# EasyEDA Pro project BlueberryPi.eprj, schematic BlueberryPi Board, sheets 1 to 8 of 13

## Sheets
1 REVISION HISTORY: Create Date: 2023-07-02; Page Name: REVISION HISTORY; Project Name: BlueberryPi; Schematic Name: BlueberryPi Board; Update Date: 2023-07-02; Company: 嘉立创EDA; Page Size: A4; Version: V1.0
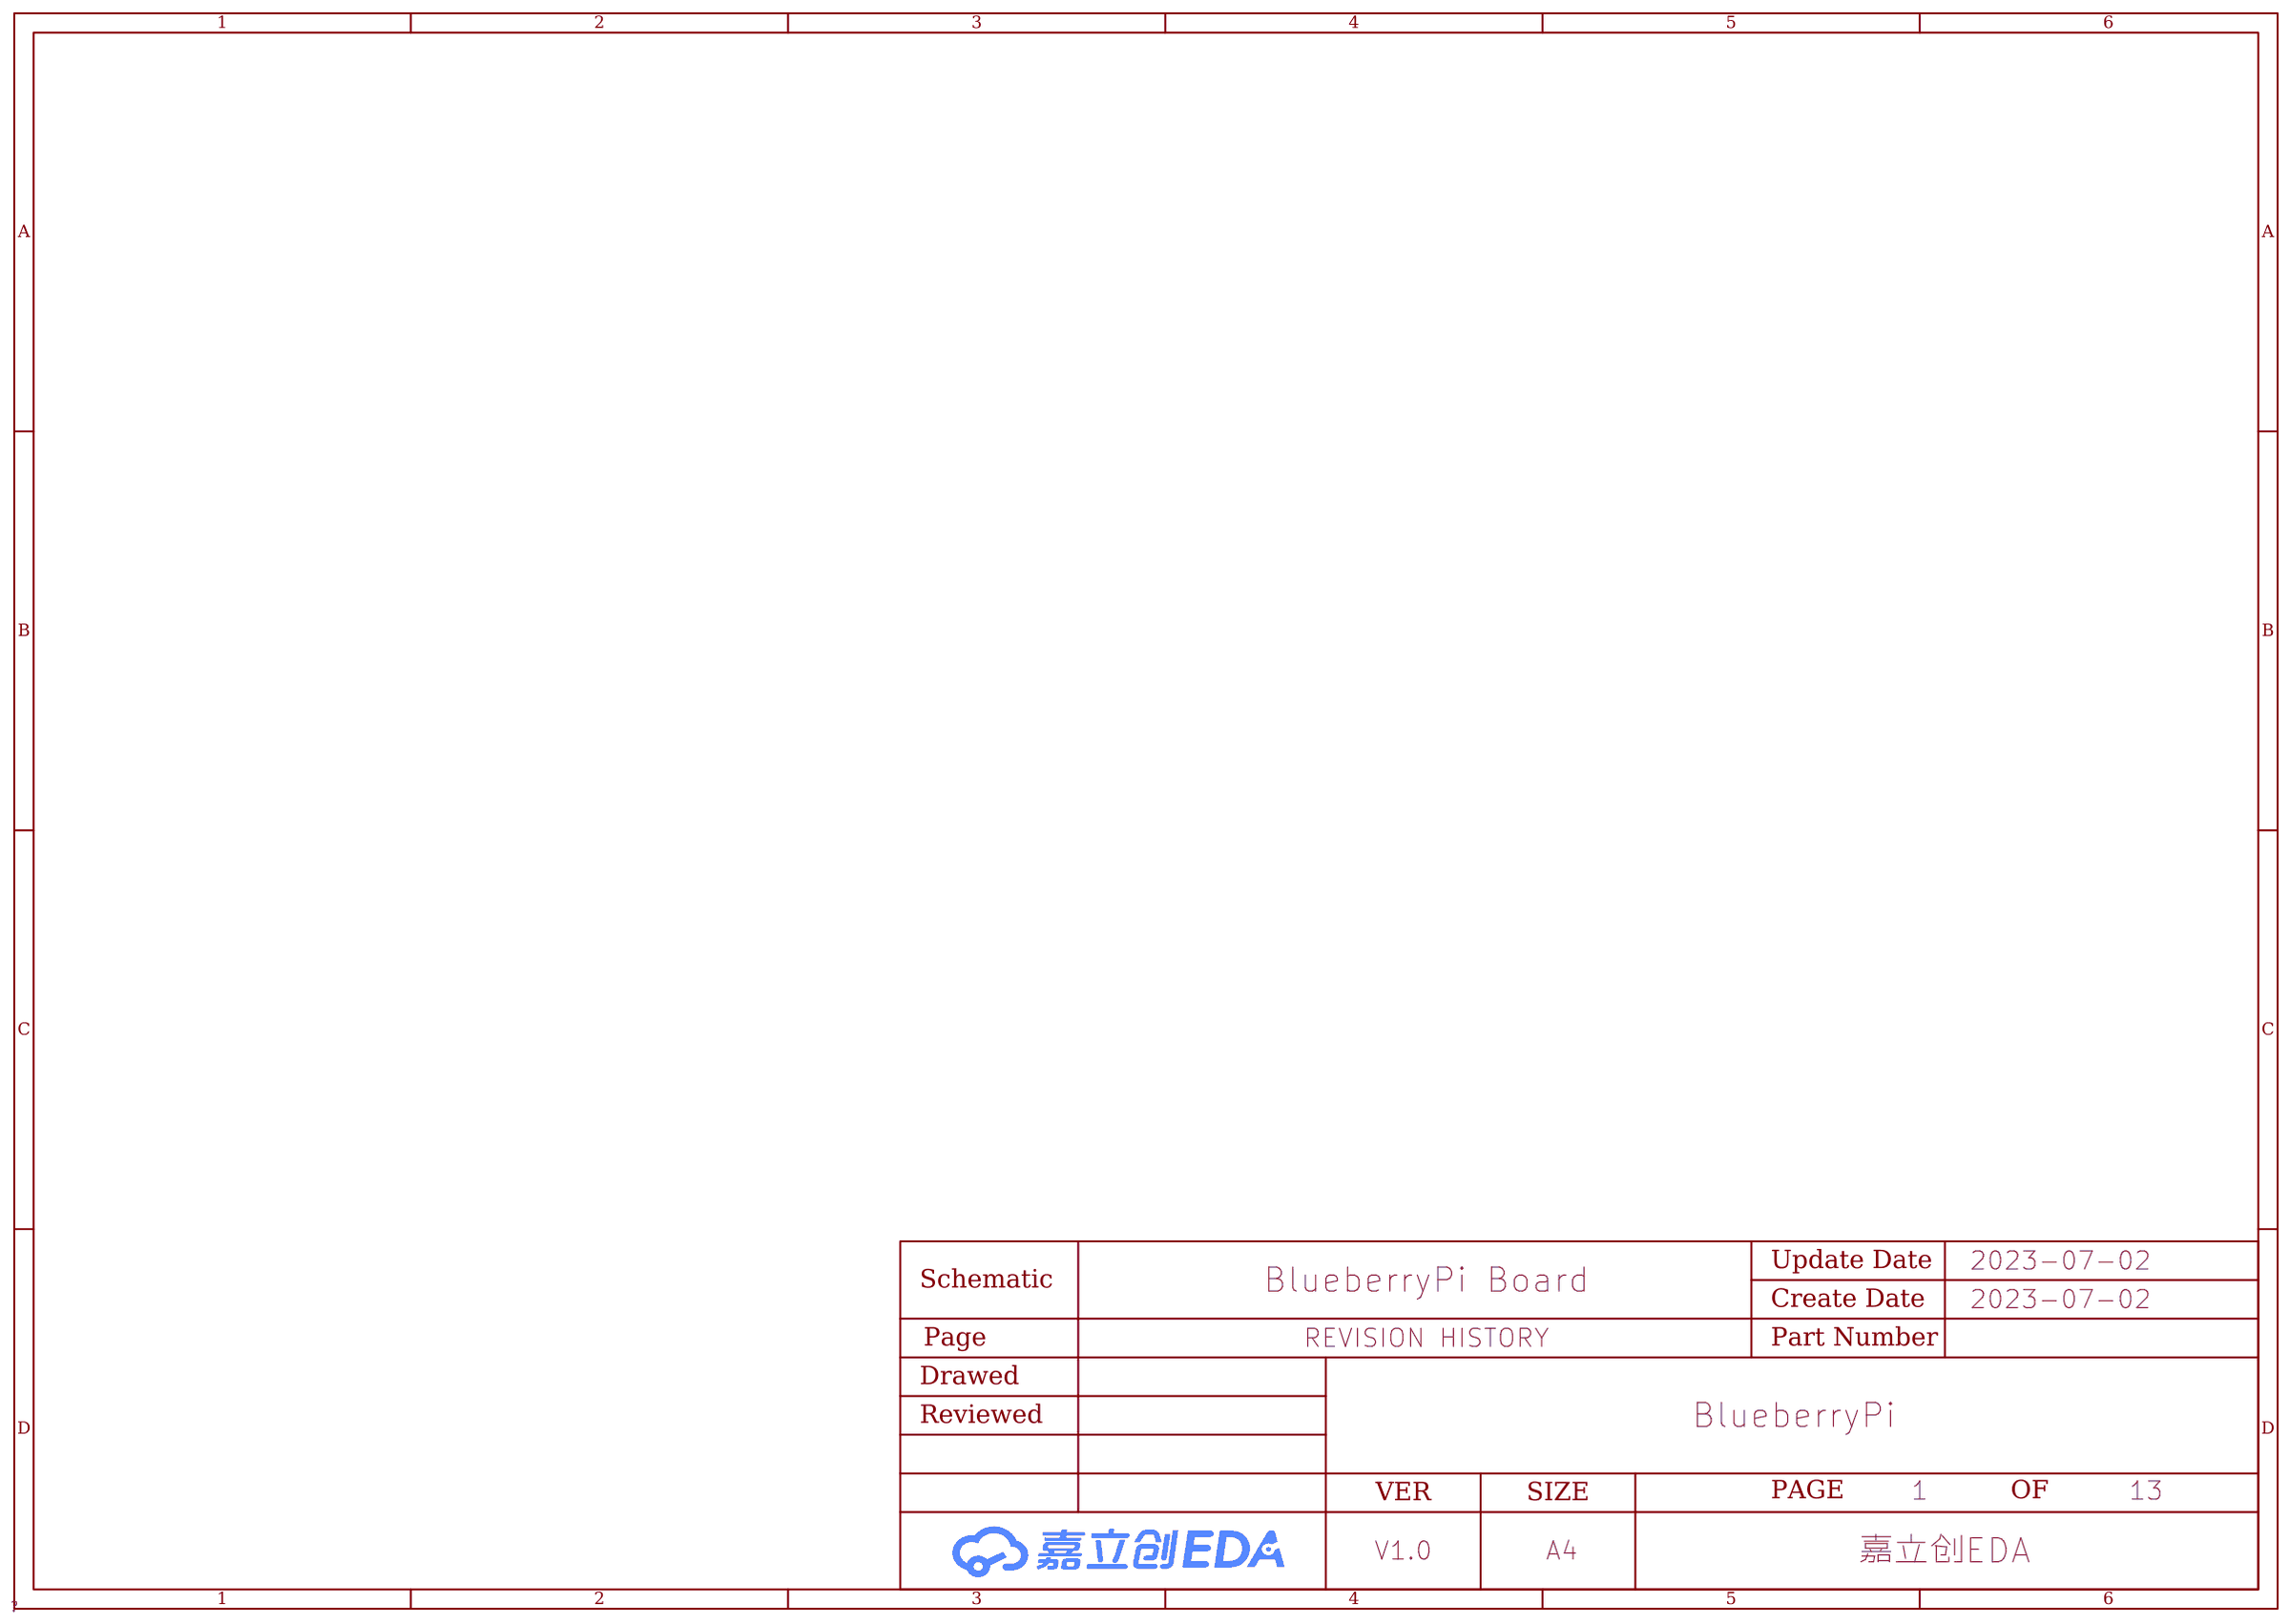
[diagram p0: REVISION HISTORY]
2 BLOCK: Page Name: BLOCK
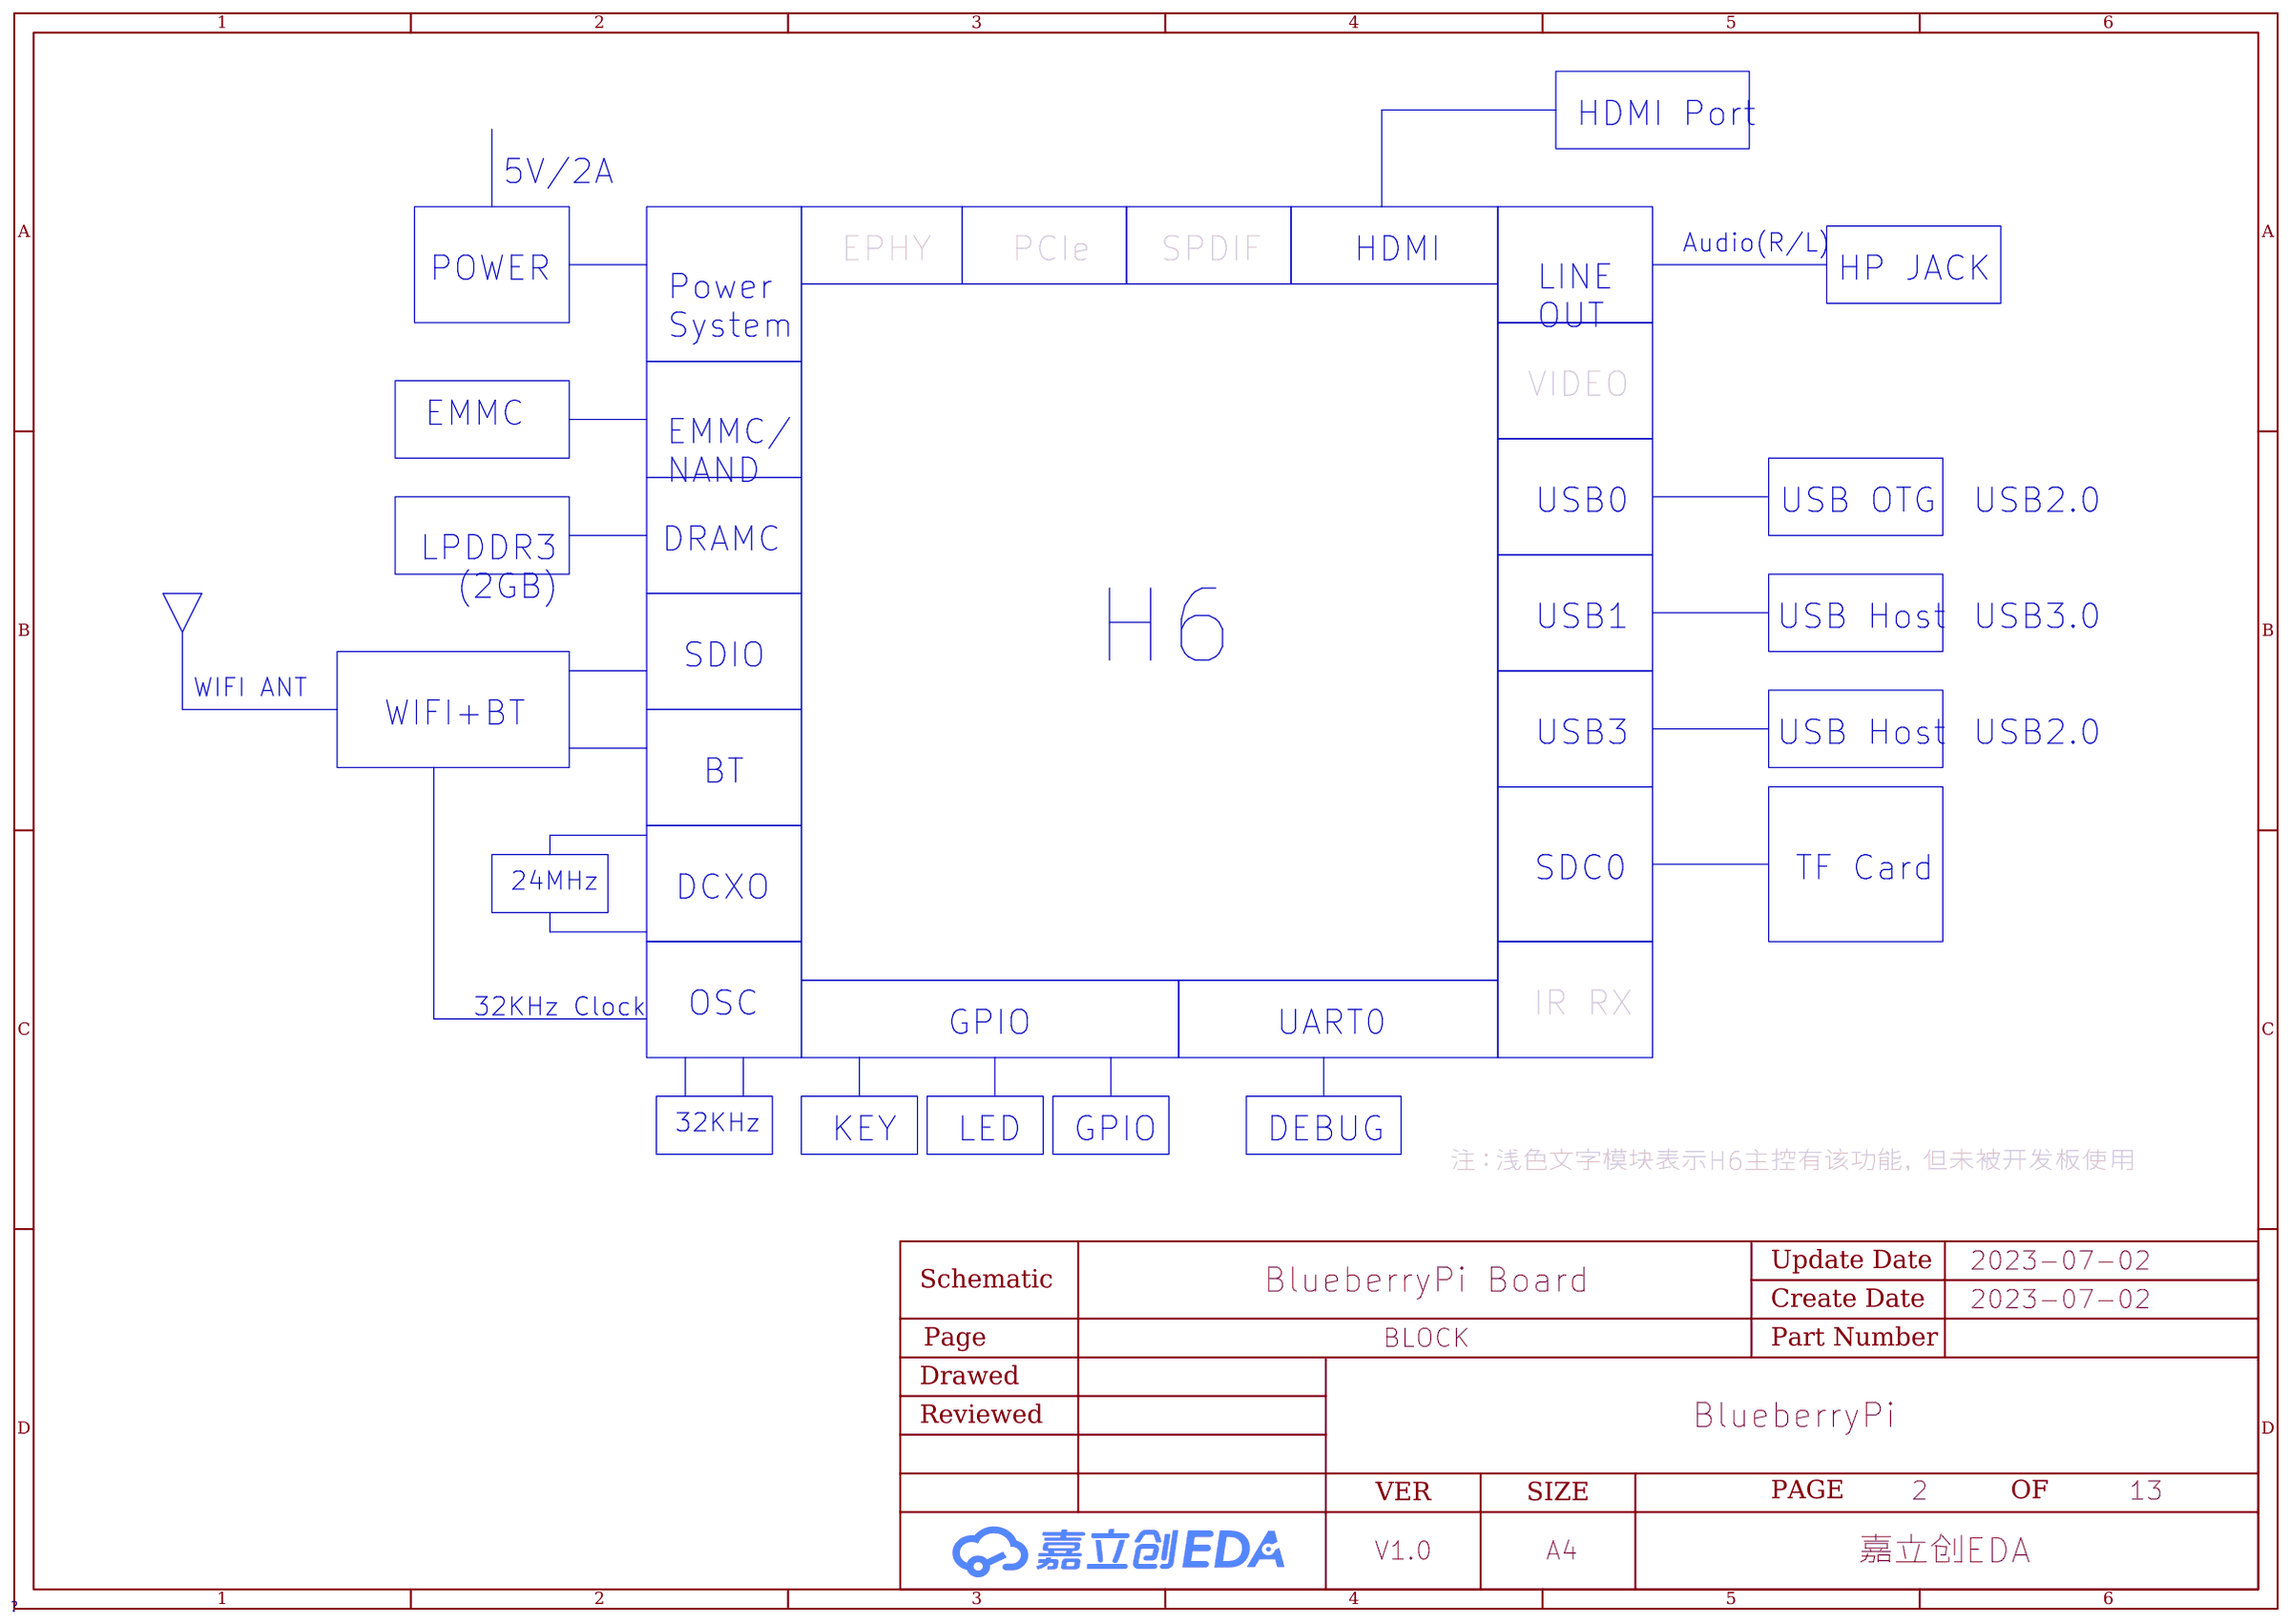
[diagram p1: BLOCK]
3 POWER TREE: Page Name: POWER TREE
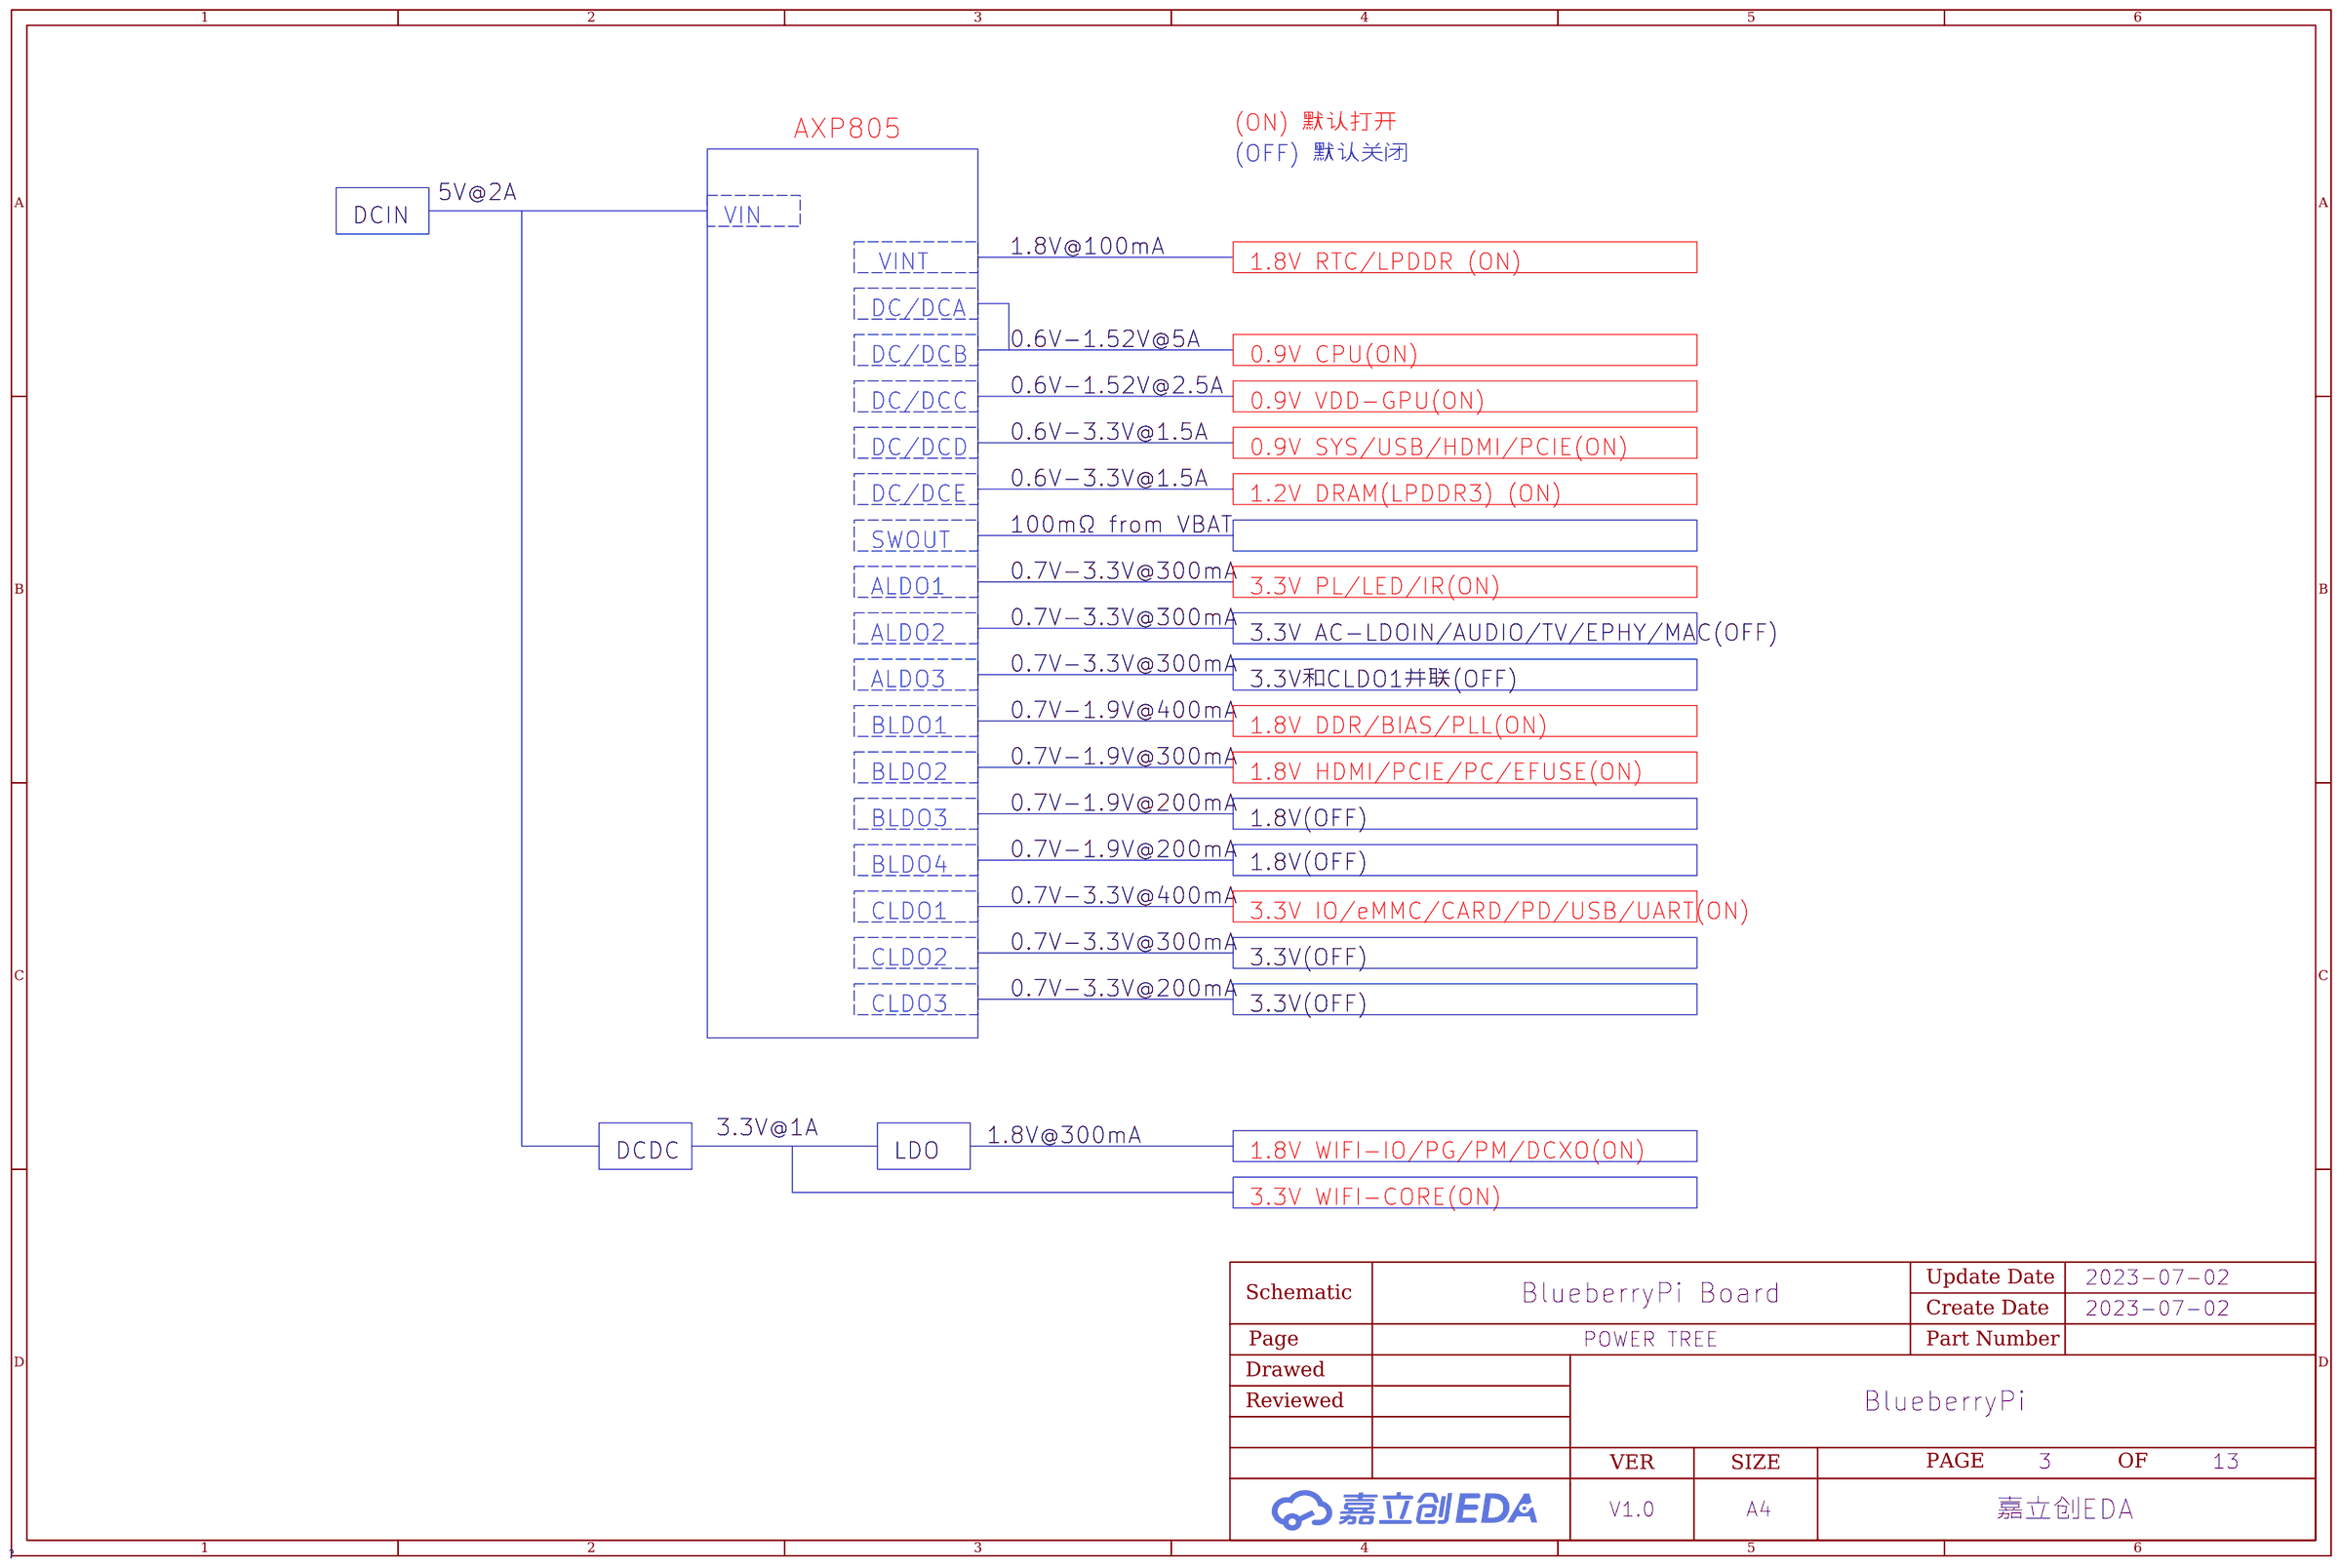
[diagram p2: POWER TREE]
4 GPIO ASSIGNMENT: Page Name: P4
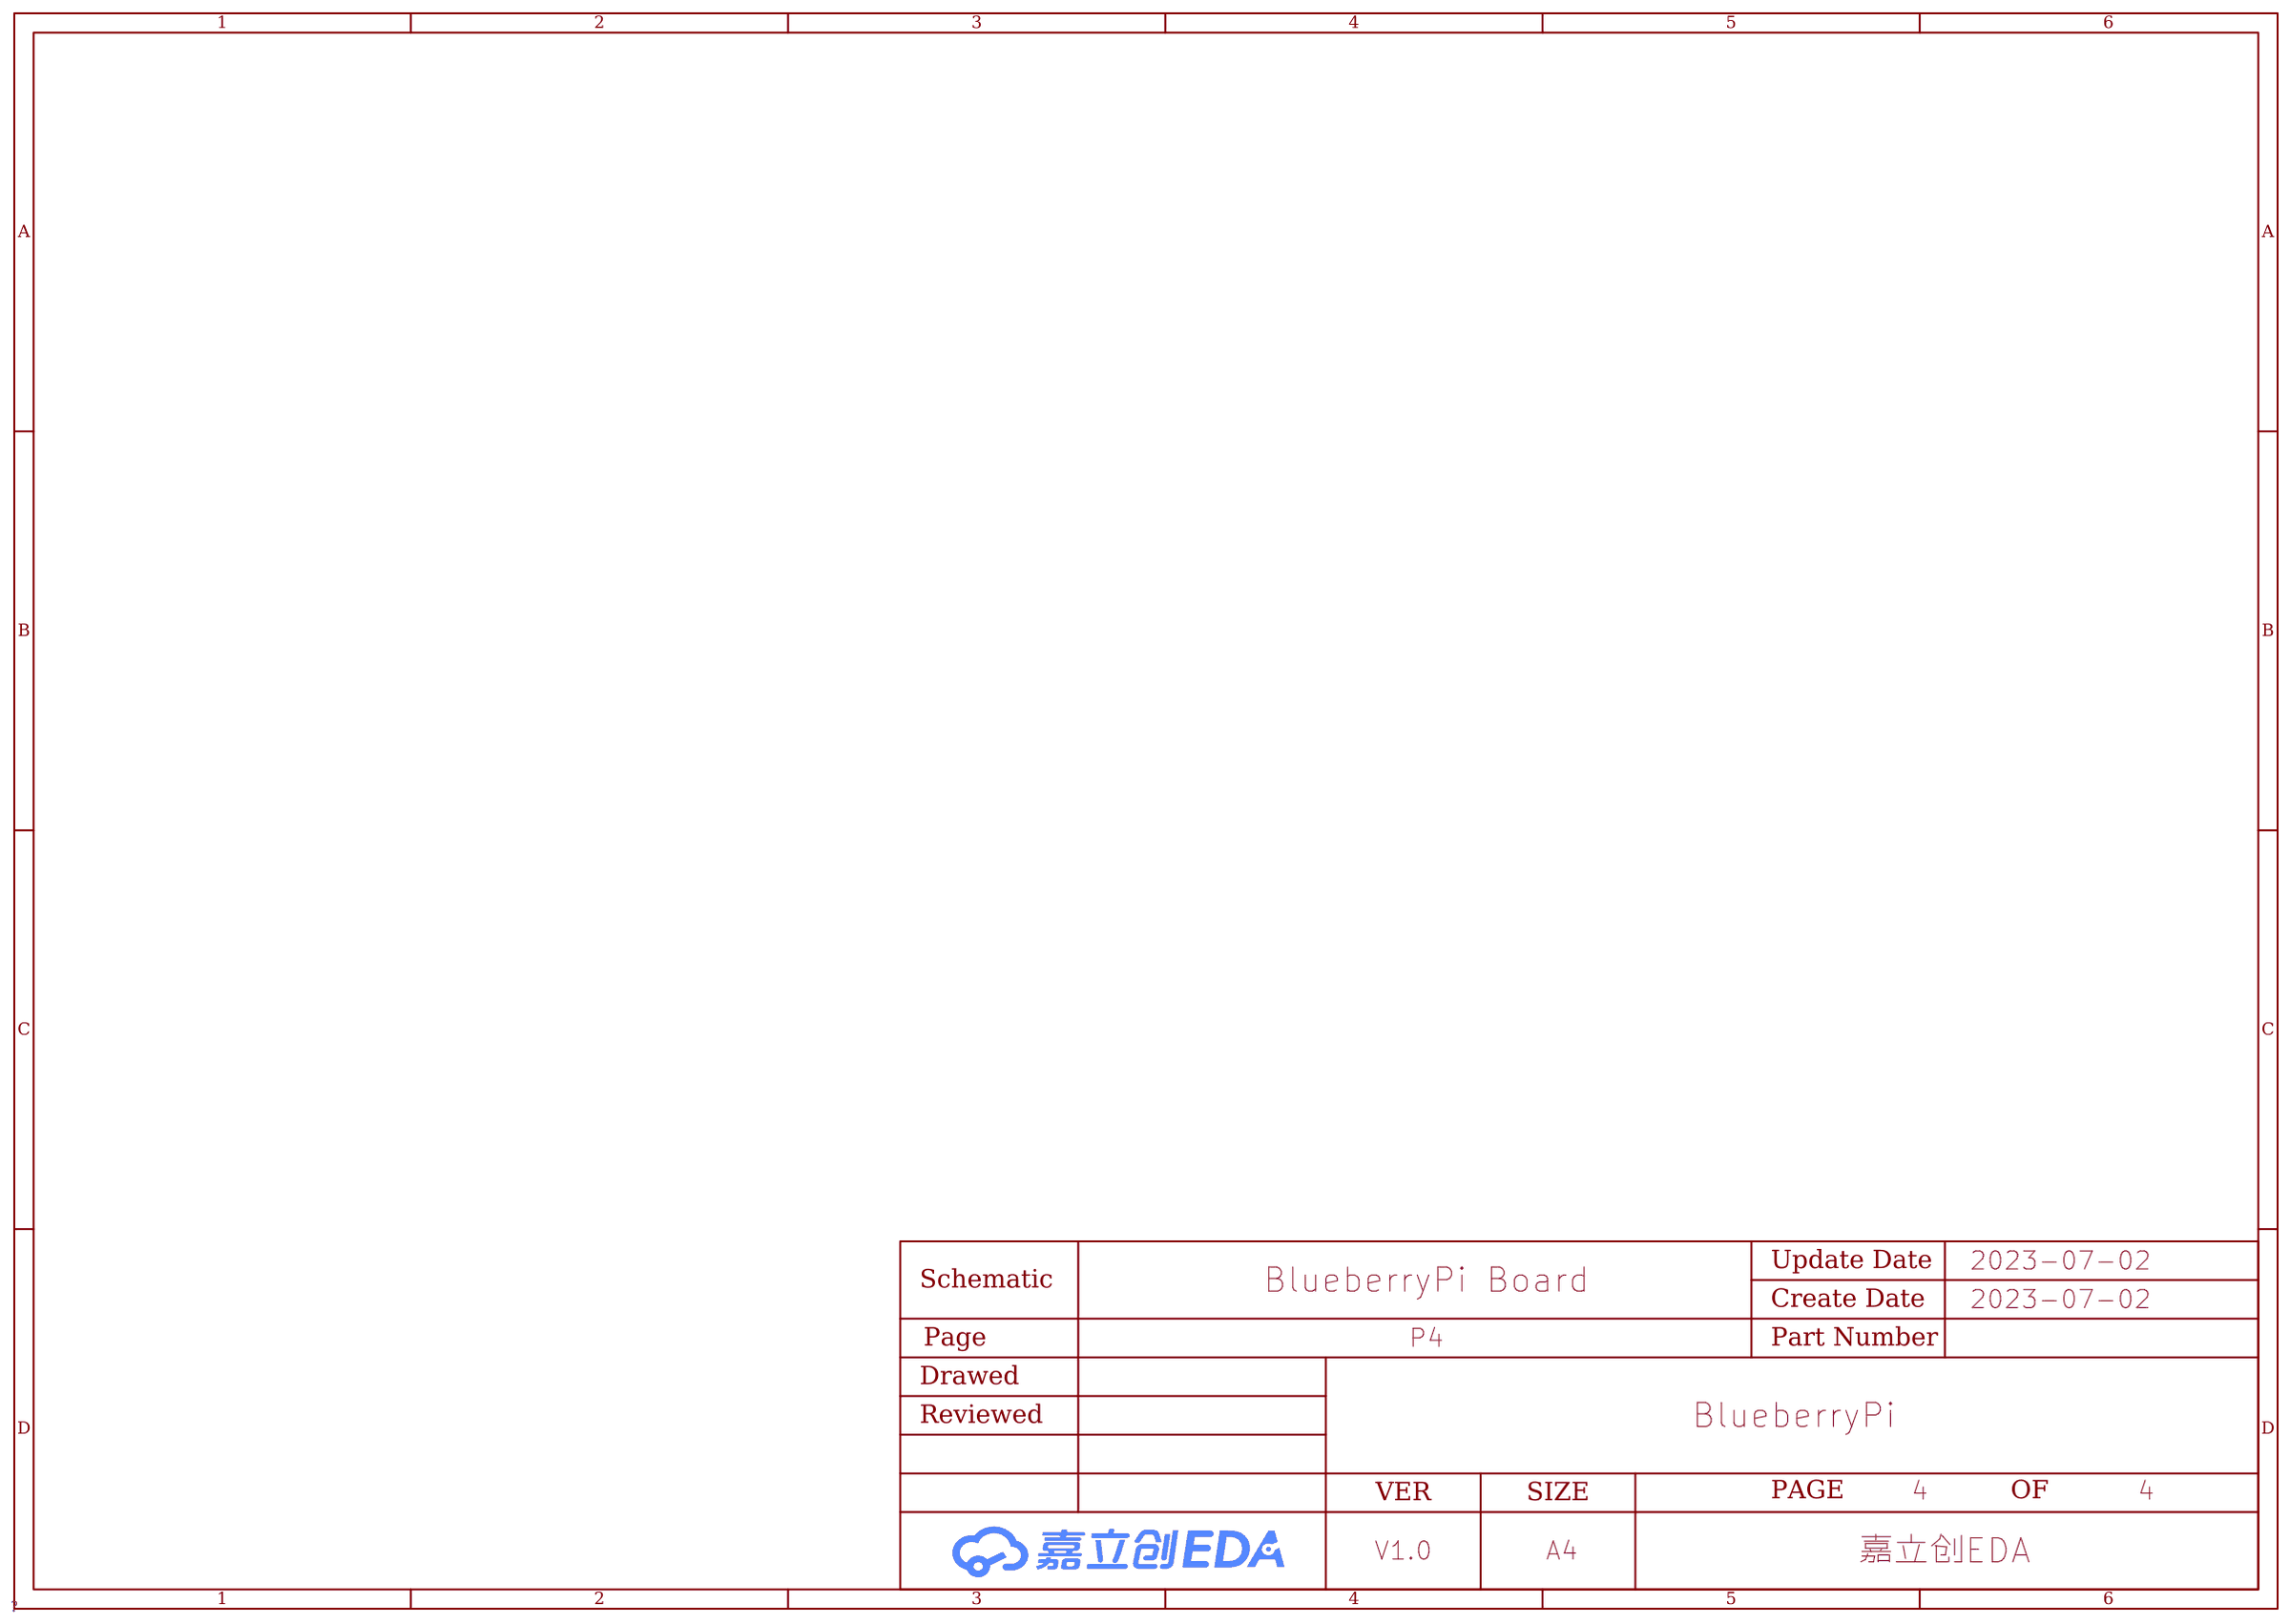
[diagram p3: GPIO ASSIGNMENT]
5 SOC1: Page Name: SOC1; Update Date: 2023-08-31